# EasyEDA Pro project test_0.eprj (continued)
## Nets (continued)

Not connected (* = marked no-connect by the designer): ADC2 24*; I2S 3*; RGB1 2(DOUT)*; U3 1*; U16 4(SENSOR_VP)* 5(SENSOR_VN)* 17(NC)* 18(NC)* 19(NC)* 20(NC)* 21(NC)* 22(NC)* 32(NC)*; U17 7(NC.)* 8(OUT#)* 9(CTS#)* 10(DSR#)* 11(RI#)* 12(DCD#)* 15(R232)*; USB1 A8(SBU1)* B8(SBU2)*

## Notes on the sheets
sheet 1
- ESP32模组
- 串口与自动下载电路
- RGB彩灯
- LED灯
- 电机控制
- 有源蜂鸣器
- 串口屏
- 超声波
- 音频播放
- 灰度检测
sheet 2
- 充电电路
- 升压电路
- 降压电路
- 充电指示灯
- 电源开关
- 外部电源输入

# Board PCB1
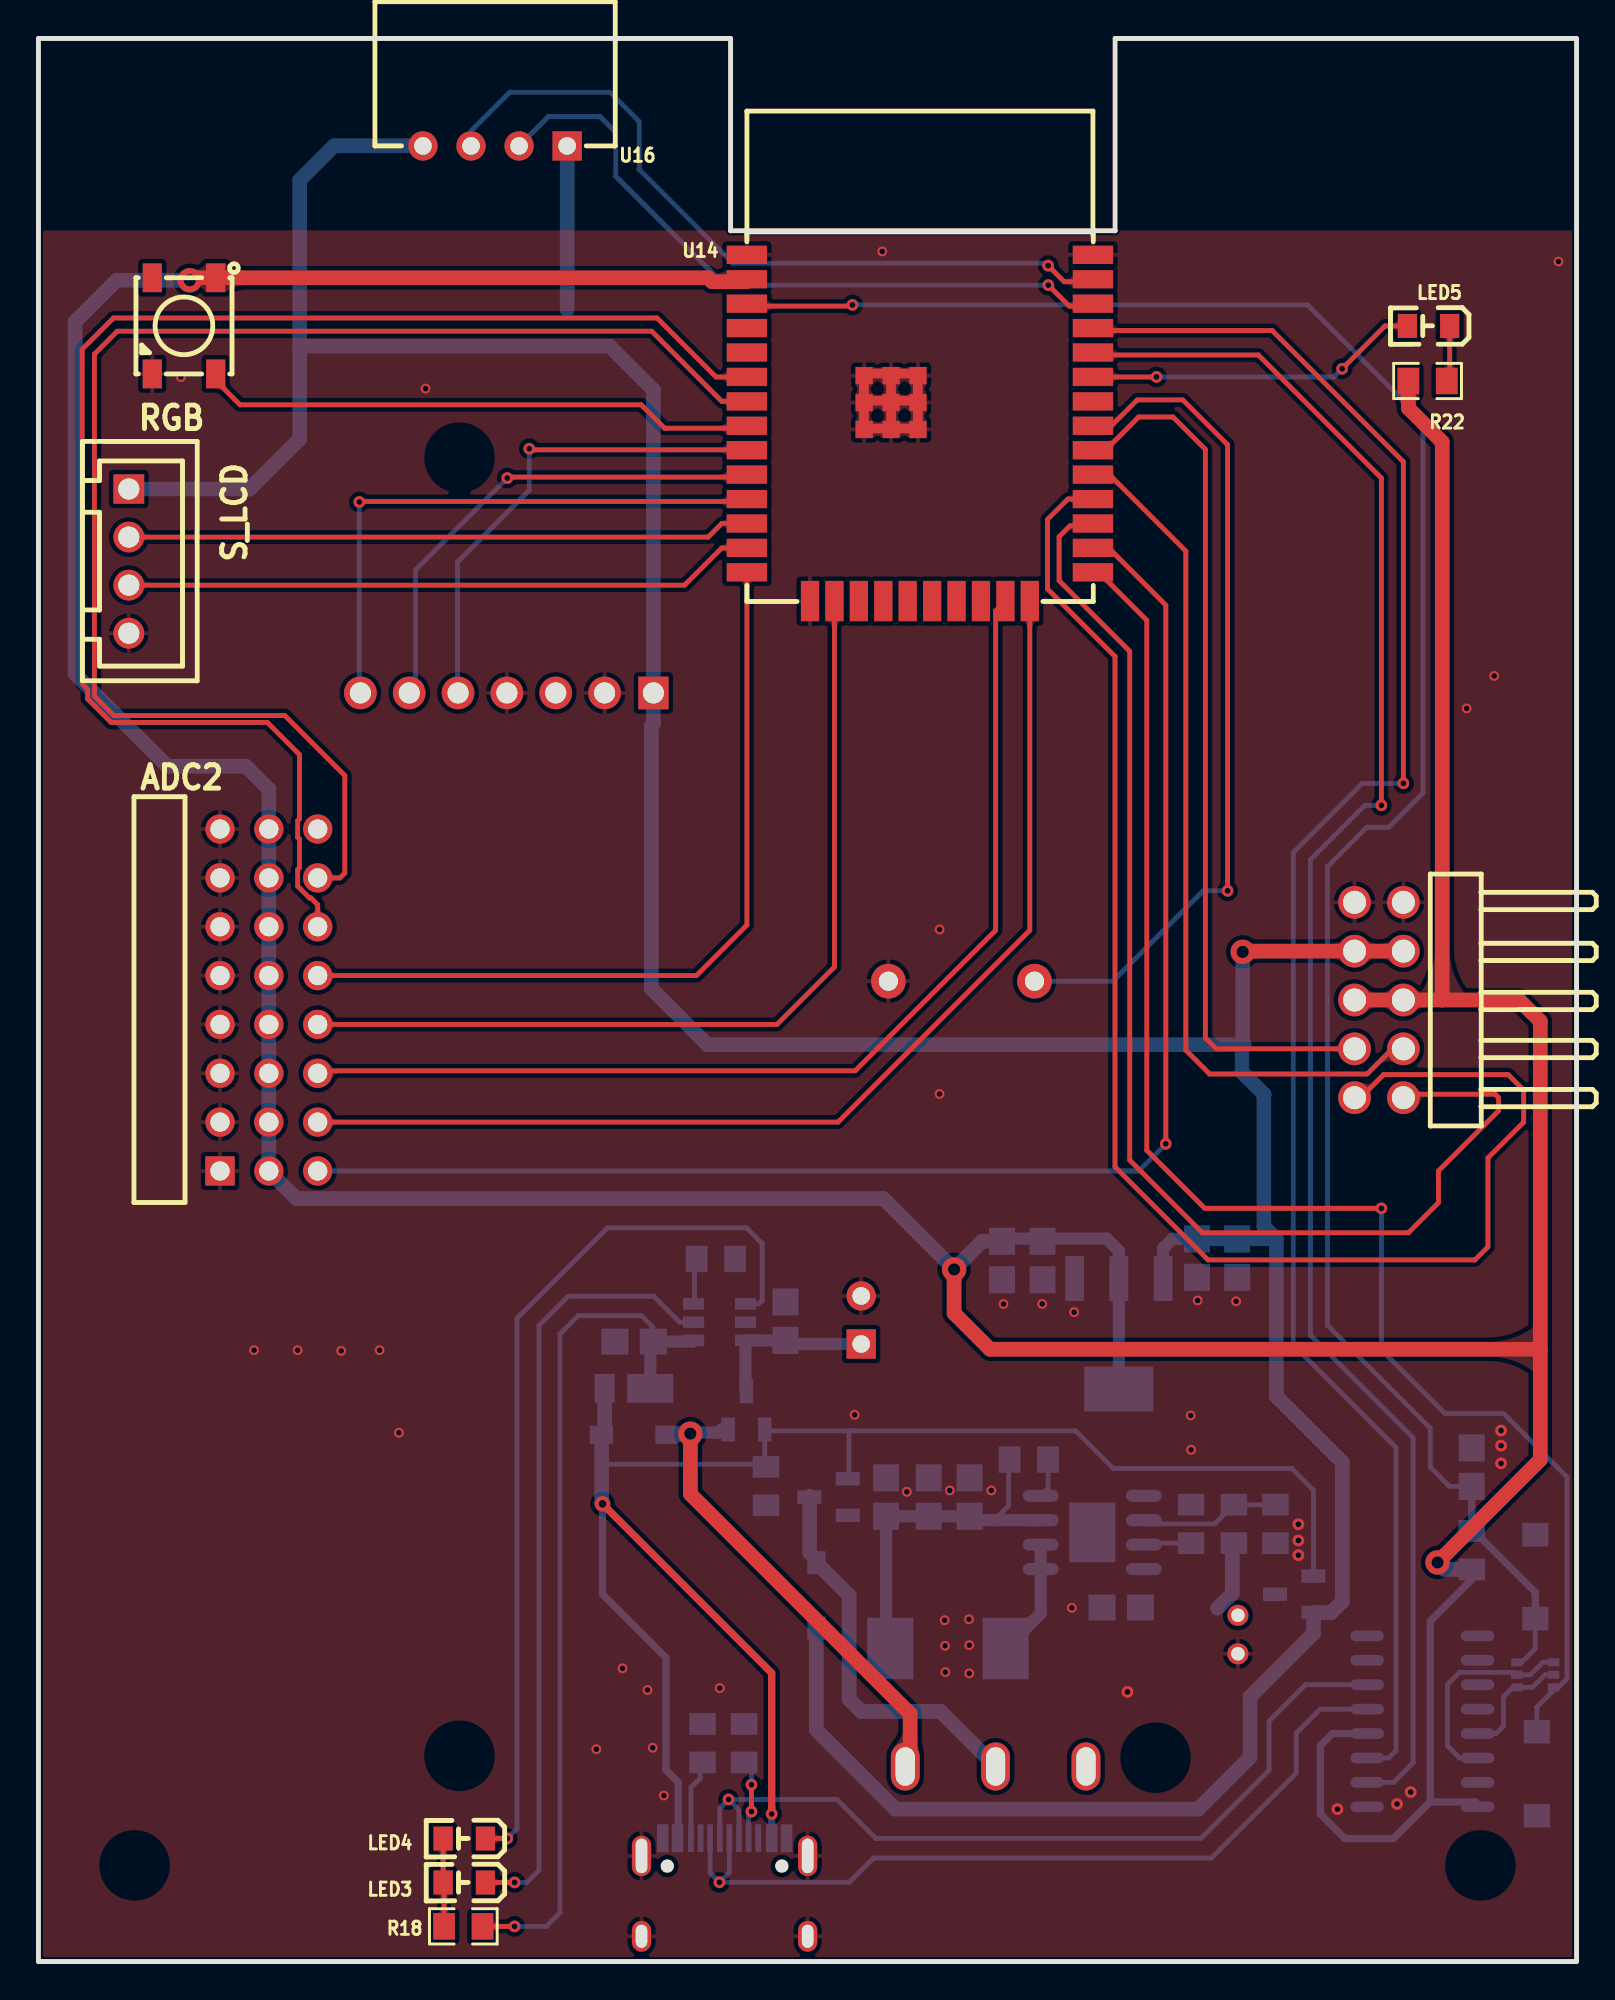
[diagram p3: board, top side]
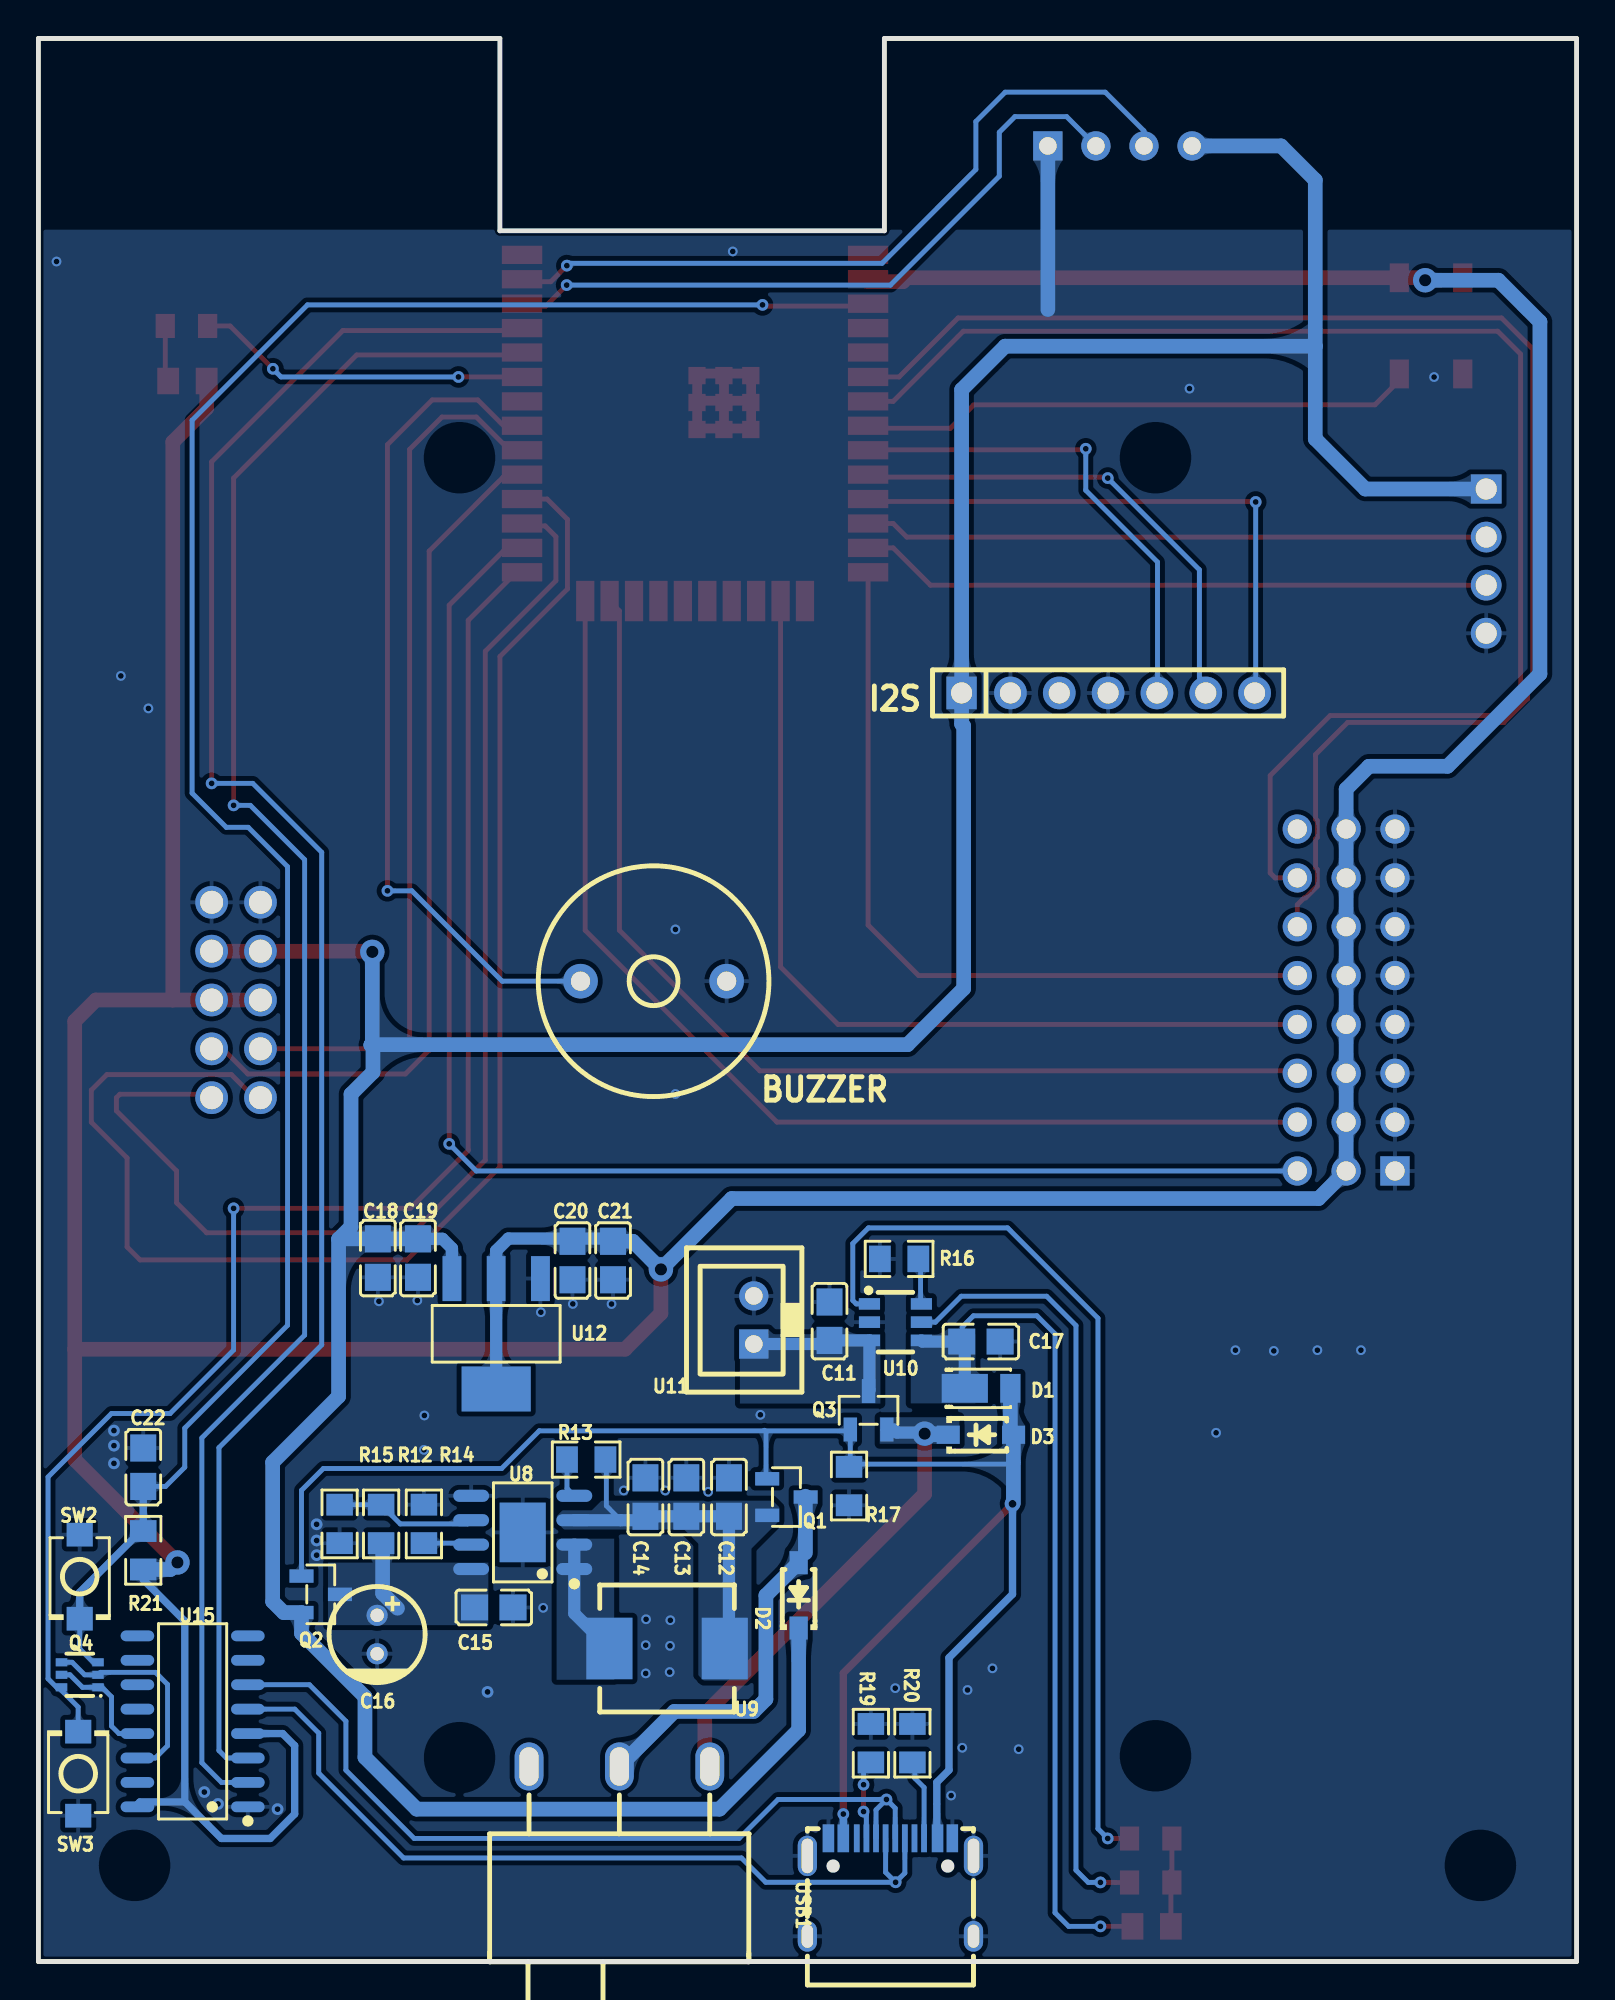
[diagram p4: board, bottom side, seen from below]

Outline 80 x 100 mm; copper layers: Top Layer, Bottom Layer. Coordinates in mm from the lower left corner of the outline.
Outline path: 0,100 36,100 36,90 56,90 56,100 80,100 80,0 0,0 0,100
Stack: Top Layer 0.035mm / Dielectric1 1.51mm FR4 er 4.5 / Bottom Layer 0.035mm

## Design rules (mm)
template: 自定义配置
spacing copperThickness1oz (default): track to track 0.102, other pairs 0.152 to 0.3
spacing copperThickness2oz: track to track 0.203, other pairs 0.152 to 0.3
track width copperThickness1oz (default): min 0.127, default 0.254, max 2.54
track width copperThickness2oz: min 0.203, default 0.254, max 2.54
differential pair differentialPair (default): width min 0.127, default 0.254, max 2.54; gap min 0.152, default 0.152
via viaSize (default): diameter min 0.5, default 0.61, max 10; hole min 0.3, default 0.305, max 6.3
net VCC uses copperRegion1
net BAT uses copperRegion1
net VBUSIN uses copperRegion1
net $2N228 uses copperRegion1
net $2N227 uses copperRegion1
net $2N477 uses copperRegion1

## Placement (name value [footprint] x y rotation side)
ADC2  HX PZ2.54-3x8P ZZ  [HDR-TH_24P-P2.54-V-M-R3-C8-S2.54_1]  11.98 50 90 top
BUZZER  2.4kHz  [BUZ-TH_BD12.0-P7.60-D0.6-FD]  48.01 50.98 180 bottom
C11  10uF  [C0805]  38.86 33.3 270 bottom
C12  22uF  [C0805]  44.09 24.15 270 bottom
C13  22uF  [C0805]  46.3 24.15 270 bottom
C14  100nF  [C0805]  48.43 24.15 270 bottom
C15  22uF  [C0805]  56.32 18.41 0 bottom
C16  100uF  [CAP-TH_BD5.0-P2.00-D0.5-FD]  62.39 17 270 bottom
C17  1uF  [C0805]  30.98 32.24 0 bottom
C18  10uF  [C0805]  62.35 36.58 90 bottom
C19  100nF  [C0805]  60.26 36.58 90 bottom
C20  10uF  [C0805]  52.22 36.45 90 bottom
C21  100nF  [C0805]  50.12 36.45 90 bottom
C22  1uF  [C0805]  74.55 25.71 270 bottom
D1  SBR3U30P1-7  [POWERDI-123_L2.8-W1.8-LS3.7-RD-1]  30.63 29.81 180 bottom
D2  MBR0530T1G  [SOD-123_L2.7-W1.6-LS3.7-RD-1]  40.46 19.04 90 bottom
D3  MBR0530T1G  [SOD-123_L2.7-W1.6-LS3.7-RD-1]  30.98 27.39 180 bottom
H2  HC-PZ254-13.8L-2x5PWA  [HDR-TH_10P-P2.54-H-M-R2-C5-S2.54-W9.7]  69.72 50 90 top
I2S  2541FV-7P-B  [HDR-TH_7P-P2.54-V-F]  24.37 65.97 180 bottom
LED3  -  [LED_0805]  22.1 4.12 180 top
LED4  -  [LED_0805]  22.1 6.4 180 top
LED5  -  [LED_0805]  72.25 85.06 180 top
Q1  -  [SOT-23-3_L2.9-W1.3-P1.90-LS2.4-BR]  41.1 24.15 0 bottom
Q2  -  [SOT-23-3_L2.9-W1.3-P1.90-LS2.4-BR]  65.32 19.09 0 bottom
Q3  -  [SOT-23-3_L2.9-W1.3-P1.90-LS2.4-BR]  36.82 28.66 270 bottom
Q4  UMH3N  [SC-70-6_L2.2-W1.3-P0.65-LS2.1-BR]  77.85 14.91 180 bottom
R12  73K  [R0805]  62.18 22.76 270 bottom
R13  1K  [R0805]  51.51 26.1 0 bottom
R14  30K  [R0805]  59.95 22.76 270 bottom
R15  10K  [R0805]  64.34 22.76 90 bottom
R16  10K  [R0805]  35.24 36.54 180 bottom
R17  100K  [R0805]  37.84 24.73 90 bottom
R18  1K  [R0805]  22.1 1.83 180 top
R19  5.1k  [R0805]  36.7 11.35 90 bottom
R20  5.1k  [R0805]  34.54 11.35 270 bottom
R21  10K  [R0805]  74.55 21.39 270 bottom
R22  10K  [R0805]  72.25 82.19 180 top
RGB  WS2812B-B  [LED-SMD_4P-L5.0-W5.0-BL_TC5050RGB]  7.57 85.06 270 top
S_LCD  ZX-XH2.54-4PZZ  [CONN-TH_4P-P2.50_4PIN]  4.7 72.82 270 top
SW2  TS-1088-AR02016  [SW-SMD_L3.9-W3.0-P4.45]  77.85 20.01 270 bottom
SW3  TS-1088-AR02016  [SW-SMD_L3.9-W3.0-P4.45]  77.93 9.77 90 bottom
U3  KH-SS12D11-G5  [SW-TH_KH-SS12D11-G5]  49.78 5.89 180 bottom
U8  -  [ESOP-8_L4.9-W3.9-P1.27-LS6.0-BL-EP3.1-1]  54.81 22.31 90 bottom
U9  3.3uH  [IND-SMD_L7.0-W6.6]  47.31 16.28 0 bottom
U10  TP4057  [SOT-23-6_L2.9-W1.6-P0.95-LS2.8-BR]  35.43 33.25 0 bottom
U11  BX-XH2.54-2PZZ  [CONN-TH_2P-P2.50_BX-XH2.54-2PZZ]  42.79 33.36 90 bottom
U12  AMS1117-3.3  [SOT-223-3_L6.7-W3.7-P2.30-LS7.0-BR]  56.19 32.64 90 bottom
U14  ESP32-WROOM-32E-H4  [WIFI-SMD_ESP32-WROOM-32E]  45.85 79.75 270 top
U15  CH340C  [SOP-16_L10.0-W3.9-P1.27-LS6.0-BL]  71.98 12.49 90 bottom
U16  ESP32-WROOM-32E-H4  [CONN-TH_4P-P2.50_WAFER-XH254WZ-4A]  23.75 94.41 180 top
USB1  TYPEC-304-BCP16  [USB-C-SMD_TYPEC-304-BCP16]  35.69 3.86 180 bottom

## Footprints (pads in the part's own frame, mm; a bottom-side part is the same pattern mirrored in y, then rotated)
BUZ-TH_BD12.0-P7.60-D0.6-FD
  round 1.8 hole 1: 1(-3.8,0) 2(3.8,0)
C0805
  rect 1.41x1.35 smd: 1(-1,0) 2(1,0)
CAP-TH_BD5.0-P2.00-D0.5-FD
  round 1.1 hole 0.7: 1(-1,0) 2(1,0)
CONN-TH_2P-P2.50_BX-XH2.54-2PZZ
  rect 1.524x1.524 hole 0.914: 1(-1.25,0)
  round 1.524 hole 0.914: 2(1.25,0)
CONN-TH_4P-P2.50_4PIN
  rect 1.524x1.6 hole 1.1: 1(-3.75,0)
  round 1.6 hole 1.1: 2(-1.25,0) 3(1.25,0) 4(3.75,0)
CONN-TH_4P-P2.50_WAFER-XH254WZ-4A
  rect 1.524x1.524 hole 0.914: 1(-3.75,0)
  round 1.524 hole 0.914: 2(-1.25,0) 3(1.25,0) 4(3.75,0)
ESOP-8_L4.9-W3.9-P1.27-LS6.0-BL-EP3.1-1
  oval 0.63x1.865 smd: 1(-1.905,-2.683) 2(-0.635,-2.683) 3(0.635,-2.683) 4(1.905,-2.683) 5(1.905,2.683) 6(0.635,2.683) 7(-0.635,2.683) 8(-1.905,2.683)
  rect 3.1x2.4 smd: 9(0,0)
HDR-TH_7P-P2.54-V-F
  rect 1.575x1.7 hole 1.1: 1(-7.62,0)
  round 1.7 hole 1.1: 2(-5.08,0) 3(-2.54,0) 4(0,0) 5(2.54,0) 6(5.08,0) 7(7.62,0)
HDR-TH_10P-P2.54-H-M-R2-C5-S2.54-W9.7
  round 1.7 hole 1.2: 1(-5.08,1.27) 2(-5.08,-1.27) 3(-2.54,1.27) 4(-2.54,-1.27) 5(0,1.27) 6(0,-1.27) 7(2.54,1.27) 8(2.54,-1.27) 9(5.08,1.27) 10(5.08,-1.27)
HDR-TH_24P-P2.54-V-M-R3-C8-S2.54_1
  rect 1.524x1.524 hole 1: 1(-8.89,2.54)
  round 1.524 hole 1: 2(-6.35,2.54) 3(-3.81,2.54) 4(-1.27,2.54) 5(1.27,2.54) 6(3.81,2.54) 7(6.35,2.54) 8(8.89,2.54) 9(-8.89,0) 10(-6.35,0) 11(-3.81,0) 12(-1.27,0) 13(1.27,0) 14(3.81,0) 15(6.35,0) 16(8.89,0) 17(-8.89,-2.54) 18(-6.35,-2.54) 19(-3.81,-2.54) 20(-1.27,-2.54) 21(1.27,-2.54) 22(3.81,-2.54) 23(6.35,-2.54) 24(8.89,-2.54)
IND-SMD_L7.0-W6.6
  rect 2.4x3.2 smd: 1(-3,0) 2(3,0)
LED-SMD_4P-L5.0-W5.0-BL_TC5050RGB
  rect 1.5x1 smd: 1(-2.5,1.65) 2(-2.5,-1.65) 3(2.5,-1.65) 4(2.5,1.65)
LED_0805
  rect 1x1.25 smd: 1(-1.15,0.005) 2(1.05,0.005)
POWERDI-123_L2.8-W1.8-LS3.7-RD-1
  rect 2.4x1.5 smd: 1(-1.188,0)
  rect 1.05x1.5 smd: 2(1.188,0)
R0805
  rect 1.133x1.377 smd: 1(-1,0) 2(1,0)
SC-70-6_L2.2-W1.3-P0.65-LS2.1-BR
  rect 0.6x0.42 smd: 1(0.95,-0.65) 2(0.95,0) 3(0.95,0.65) 4(-0.95,0.65) 5(-0.95,0) 6(-0.95,-0.65)
SOD-123_L2.7-W1.6-LS3.7-RD-1
  rect 1.2x0.95 smd: 1(-1.7,0) 2(1.7,0)
SOP-16_L10.0-W3.9-P1.27-LS6.0-BL
  oval 0.56x1.745 smd: 1(-4.445,-2.873) 2(-3.175,-2.873) 3(-1.905,-2.873) 4(-0.635,-2.873) 5(0.635,-2.873) 6(1.905,-2.873) 7(3.175,-2.873) 8(4.445,-2.873) 9(4.445,2.873) 10(3.175,2.873) 11(1.905,2.873) 12(0.635,2.873) 13(-0.635,2.873) 14(-1.905,2.873) 15(-3.175,2.873) 16(-4.445,2.873)
SOT-23-3_L2.9-W1.3-P1.90-LS2.4-BR
  rect 1.25x0.7 smd: 1(1,-0.95) 2(1,0.95) 3(-1,0)
SOT-23-6_L2.9-W1.6-P0.95-LS2.8-BR
  rect 1.1x0.6 smd: 1(1.35,-0.95) 2(1.35,0) 3(1.35,0.95) 4(-1.35,0.95) 5(-1.35,0) 6(-1.35,-0.95)
SOT-223-3_L6.7-W3.7-P2.30-LS7.0-BR
  rect 2.34x0.98 smd: 1(2.87,-2.3) 2(2.87,0) 3(2.87,2.3)
  rect 2.34x3.6 smd: 4(-2.87,0)
SW-SMD_L3.9-W3.0-P4.45
  rect 1.23x1.36 smd: 1(-2.185,0) 2(2.185,0)
SW-TH_KH-SS12D11-G5
  oval 1.5x2.5 hole 1x2: 1(-4.7,4.25) 2(0,4.25) 3(4.7,4.25)
USB-C-SMD_TYPEC-304-BCP16
  oval 1x2.1 hole 0.6x1.8: 13(-4.32,1.633) 14(4.32,1.633)
  oval 1x1.6 hole 0.6x1.2: 15(-4.32,-2.547) 16(4.32,-2.547)
  rect 0.6x1.45 smd: A1B12(-3.225,2.547) A4B9(-2.45,2.547) B1A12(3.22,2.547) B4A9(2.45,2.547)
  rect 0.3x1.45 smd: A5(-1.25,2.547) A6(-0.25,2.547) A7(0.25,2.547) A8(1.25,2.547) B5(1.75,2.547) B6(0.75,2.547) B7(-0.75,2.547) B8(-1.75,2.547)
WIFI-SMD_ESP32-WROOM-32E
  rect 0.95x2.1 smd: 1(-9.002,-9) 2(-7.732,-9) 3(-6.463,-9) 4(-5.192,-9) 5(-3.922,-9) 6(-2.652,-9) 7(-1.383,-9) 8(-0.113,-9) 9(1.157,-9) 10(2.428,-9) 11(3.697,-9) 12(4.968,-9) 13(6.237,-9) 14(7.508,-9) 25(7.508,9) 26(6.237,9) 27(4.968,9) 28(3.697,9) 29(2.428,9) 30(1.157,9) 31(-0.113,9) 32(-1.383,9) 33(-2.652,9) 34(-3.922,9) 35(-5.192,9) 36(-6.463,9) 37(-7.732,9) 38(-9.002,9)
  rect 2.1x0.95 smd: 15(9.002,-5.715) 16(9.002,-4.445) 17(9.002,-3.175) 18(9.002,-1.905) 19(9.002,-0.635) 20(9.002,0.635) 21(9.002,1.905) 22(9.002,3.175) 23(9.002,4.445) 24(9.002,5.715)
  rect 0.9x0.9 smd: 39(-2.721,-0.1) 39(-2.721,-1.5) 39(-2.721,-2.9) 39(-1.321,-0.1) 39(-1.321,-1.5) 39(-1.321,-2.9) 39(0.079,-0.1) 39(0.079,-1.5) 39(0.079,-2.9)

## Nets
3V3: ADC2.9 ADC2.10 ADC2.11 ADC2.12 ADC2.13 ADC2.14 ADC2.15 ADC2.16 C20.2 C21.2 H2.5 H2.6 R21.2 R22.2 RGB.1 U12.2 U12.4 U14.2 U15.4 U15.16
5V: C18.2 C19.2 D2.1 H2.7 H2.8 I2S.1 Q2.2 S_LCD.1 U12.3 U16.4
GND: ADC2.1 ADC2.2 ADC2.3 ADC2.4 ADC2.5 ADC2.6 ADC2.7 ADC2.8 BUZZER.2 C11.1 C12.1 C13.1 C14.1 C15.1 C16.2 C17.1 C18.1 C19.1 C20.1 C21.1 C22.1 H2.9 H2.10 I2S.2 I2S.4 R14.1 R15.1 R16.1 R17.1 R19.2 R20.1 RGB.3 S_LCD.4 SW2.1 SW3.1 U8.5 U8.9 U10.2 U11.2 U12.1 U14.1 U14.15 U14.38 U14.39 U15.1 U16.1 USB1.13 USB1.14 USB1.15 USB1.16 USB1.A1B12 USB1.B1A12
VBUS: D1.2 D3.2 Q1.1 Q2.1 Q3.1 R17.2 USB1.A4B9 USB1.B4A9
VBUSIN: D3.1 Q3.2 U3.3
VCC: C17.2 D1.1 R18.1 U10.4
VIN: D2.2 Q1.3 U3.2
340_D+: U15.5 USB1.A6 USB1.B6
340_D-: U15.6 USB1.A7 USB1.B7
ADC1_6: ADC2.22 U14.6
ADC1_7: ADC2.23 U14.7
ADC2_0: ADC2.17 U14.26
ADC2_1: Q4.6 SW3.2 U14.25
ADC2_2: ADC2.18 U14.24
ADC2_3: ADC2.19 U14.23
ADC2_4: ADC2.20 U14.16
ADC2_5: ADC2.21 U14.14
BAT: C11.2 Q3.3 U10.3 U11.1
BEEP: BUZZER.1 U14.31
CHIP_PU: C22.2 Q4.3 R21.1 SW2.2 U14.3
CHRG: LED4.1 U10.1
DIRE1: H2.3 U14.30
DIRE2: H2.4 U14.29
DTR: Q4.1 Q4.5 U15.13
ECHO: U14.36 U16.2
I2S_1: I2S.5 U14.9
I2S_2: I2S.6 U14.10
I2S_3: I2S.7 U14.11
LED: LED5.2 U14.33
PWM1: H2.1 U14.28
PWM2: H2.2 U14.27
RGB: RGB.4 U14.8
RTS: Q4.2 Q4.4 U15.14
RX: S_LCD.2 U14.12
RXD0: U14.34 U15.2
STDBY: LED3.1 U10.5
TRIG: U14.37 U16.3
TX: S_LCD.3 U14.13
TXD0: U14.35 U15.3
$2N227: U8.1 U8.2 U9.2
$2N228: C12.2 C13.2 C14.2 Q1.2 R13.1 U8.3 U9.1
$2N230: R13.2 U8.4
$2N472: R14.2 U8.7
$2N473: R12.1 R15.2 U8.6
$2N477: C15.2 C16.1 Q2.3 R12.2 U8.8
$2N943: R19.1 USB1.A5
$2N948: R20.2 USB1.B5
$2N1528: R16.2 U10.6
$2N1721: LED3.2 LED4.2 R18.2
$3N5638: LED5.1 R22.1

Pads without a net: ADC2 24; I2S 3; RGB 2; U3 1; U14 4 5 17 18 19 20 21 22 32; U15 7 8 9 10 11 12 15; USB1 A8 B8

## Via types
v1: diameter 0.508, hole 0.3, Top Layer to Bottom Layer, 37 vias
v2: diameter 0.61, hole 0.305, Top Layer to Bottom Layer, 31 vias
v3: diameter 0.813, hole 0.406, Top Layer to Bottom Layer, 1 via
v4: diameter 1.27, hole 0.635, Top Layer to Bottom Layer, 5 vias

## Routing (per net, layer and track width the routed paths; a pad name or vN(x,y) marks a point on that pad's centre or on a via; arc(x,y) is an arc through that point)
3V3: length 278.1
  Top Layer w0.762: v4(72.77,20.75) 78.11,26.09 78.11,31.84 ; 78.11,31.84 78.11,48.9 77.01,50 73.01,50 ; 78.11,31.84 49.49,31.84 47.62,33.71 v4(47.62,35.99) ; R22.2 71.25,80.78 73.01,79.01 73.01,50 ; H2.5 73.01,50 ; 36.85,87.35 35.03,87.35 34.83,87.56 RGB.1 8,87.56 v4(7.87,87.43)
  Bottom Layer w0.381: U15.4 67.3,11.85 66.68,11.23 66.68,7.67 67.94,6.4 70.49,6.4 72.39,8.31 ; R21.2 74.55,19.86 72.39,17.7 72.39,8.31 ; 72.39,8.31 72.39,8.3 74.73,8.3 74.85,8.17 U15.16
  Bottom Layer w0.635: U12.4 U12.2 56.19,36.96 55.56,37.6 50.26,37.6
  Bottom Layer w0.762: R21.2 73.14,20.39 v4(72.77,20.75) ; 11.98,44.26 ADC2.11 ADC2.12 ADC2.13 ADC2.14 ADC2.15 ADC2.16 11.98,60.97 10.8,62.15 6.71,62.15 1.91,66.96 1.91,85.27 4.06,87.43 v4(7.87,87.43) ; C21.2 49.09,37.45 v4(47.62,35.99) 43.94,39.67 13.42,39.67 ADC2.9 ADC2.10
5V: length 206.5
  Top Layer w0.762: v4(62.64,52.5) 62.67,52.54 H2.7 70.99,52.54
  Bottom Layer w0.635: U12.3 58.49,37.09 58.98,37.58 C19.2
  Bottom Layer w0.762: 62.69,47.68 62.71,47.66 62.6,47.55 62.6,46.25 63.74,45.1 63.74,38.21 64.37,37.58 ; 62.69,47.68 62.64,47.73 v4(62.64,52.5) ; 62.69,47.68 34.8,47.68 31.88,50.6 31.88,64.25 31.99,64.36 I2S.1 31.99,81.73 29.72,84 13.59,84 ; 13.59,84 13.59,79.18 10.98,76.57 S_LCD.1 ; 13.59,84 13.59,92.63 15.37,94.41 U16.4 ; C19.2 C18.2 64.37,37.58 ; 64.37,37.58 64.39,37.56 64.39,29.39 67.82,25.96 67.82,18.72 67.24,18.14 Q2.2 66.32,17.07 63.02,13.77 63.02,10.62 60.32,7.93 44.58,7.93 40.46,12.04 D2.1
GND: length 25.9
  Top Layer w0.508: 44.34,81.16 45.74,81.16 ; 44.34,81.16 44.34,79.72 ; 44.34,81.16 44.34,82.57 ; 44.34,81.16 42.93,81.16 ; 45.74,81.16 45.77,81.16 45.79,81.18 ; 45.74,81.16 45.74,82.55 ; 45.74,81.16 45.74,79.8 ; 44.35,79.72 45.66,79.72 45.74,79.8 ; 44.34,82.59 44.34,82.57 ; 44.34,82.57 45.74,82.57 ; 44.34,82.57 42.93,82.57 ; 42.93,79.72 42.93,81.16 ; 42.93,79.72 42.85,79.72 ; 42.93,79.72 42.93,79.7 42.86,79.63 ; 42.93,79.72 44.34,79.72 ; 42.93,81.16 42.9,81.16 ; 42.93,81.16 42.93,82.57 ; 44.34,79.72 44.34,79.68 44.32,79.66 ; 42.93,82.57 42.91,82.59 ; 45.74,79.8 45.77,79.83
  Bottom Layer w0.762: U16.1 27.5,85.9
  vias: v1(7.41,82.39) v1(11.21,31.79) v1(13.48,31.79) v1(15.75,31.75) v1(17.74,31.79) v1(18.75,27.5) v1(20.13,81.79) v1(29.02,11.04) v1(30.38,15.25) v1(31.68,14.12) v1(31.95,11.12) v1(32.53,8.63) v1(35.44,14.22) v1(42.45,28.43) v1(43.89,88.92) v1(45.17,24.43) v1(46.87,53.67) v1(46.87,45.11) v1(47.13,17.75) v1(47.15,16.42) v1(47.17,15.05) v1(47.4,24.5) v1(48.4,17.8) v1(48.41,16.45) v1(48.41,14.98) v1(49.56,24.5) v1(50.19,34.19) v1(52.21,34.2) v1(53.75,18.39) v1(53.87,33.76) v1(59.93,28.39) v1(59.95,26.61) v1(60.29,34.38) v1(62.29,34.33) v1(74.28,65.16) v1(75.72,66.85) v1(79.06,88.4) v2(56.64,14.02) v2(65.53,22.74) v2(65.53,21.9) v2(65.53,21.13) v2(67.56,7.93) v2(70.66,8.19) v2(71.37,8.81) v2(76.07,27.61) v2(76.07,26.83) v2(76.07,25.91)
VBUS: length 93
  Top Layer w0.381: v2(38.14,7.67) 38.14,15 v3(29.34,23.8)
  Bottom Layer w0.254: 37.89,27.64 37.93,27.59 42.21,27.59 ; 37.77,25.79 Q3.1 ; Q2.1 66.32,24.5 65.18,25.64 55.91,25.64 53.95,27.6 42.22,27.6 ; 37.72,25.86 29.37,25.86 29.29,25.94 ; 42.16,27.54 42.16,25.22 ; 42.24,27.62 42.22,27.6 ; 42.22,27.6 42.21,27.59
  Bottom Layer w0.381: 29.29,23.85 v3(29.34,23.8) 29.34,19.1 32.64,15.8 32.64,9.96 33.27,9.32 33.27,8.22 ; 33.27,8.15 33.27,6.45 33.24,6.41 ; USB1.A4B9 v2(38.14,7.67)
  Bottom Layer w0.762: D1.2 29.45,27.56 D3.2 29.29,27.38 29.29,23.86
VBUSIN: length 26.7
  Top Layer w0.762: U3.3 45.34,10.4 45.34,12.88 33.91,24.31 33.91,27.48
  Bottom Layer w0.635: D3.1 32.79,27.51 35.35,27.51 35.51,27.66 Q3.2
  Bottom Layer w0.762: D3.1 33.85,27.39 v4(33.91,27.45)
VCC: length 45
  Top Layer w0.254: v2(24.76,1.83) R18.1
  Bottom Layer w0.254: 31.95,32.24 31.95,33 31.37,33.58 28.07,33.58 27.13,32.64 27.13,2.54 26.42,1.83 v2(24.76,1.83)
  Bottom Layer w0.635: U10.4 34.02,32.24 C17.2 ; 31.82,29.81 31.82,32.08
VIN: length 19.8
  Bottom Layer w0.762: D2.2 42.16,19.04 42.16,13.64 42.8,13 46.92,13 U3.2 ; 40.11,24.2 40.11,21.25
340_D+: length 43.6
  Bottom Layer w0.254: USB1.A6 35.94,4.64 v2(35.42,4.12) ; U15.5 66.67,13.12 65.42,11.88 65.42,9.8 61.01,5.38 43.43,5.38 42.17,4.12 v2(35.42,4.12) ; USB1.B6 34.94,4.6 v2(35.42,4.12)
340_D-: length 43.3
  Bottom Layer w0.254: v2(35.89,8.43) 41.53,8.43 43.56,6.4 60.46,6.4 64.01,9.95 64.01,12.5 65.91,14.39 U15.6 ; v2(35.89,8.43) 35.44,7.97 USB1.A7 ; v2(35.89,8.43) 36.44,7.88 USB1.B7
ADC1_6: length 76.6
  Top Layer w0.254: U14.6 35.24,82.4 32.17,85.47 3.9,85.47 2.27,83.84 2.27,66.44 2.55,66.16 2.55,65.66 3.78,64.43 11.91,64.43 13.58,62.76 13.58,59.42 13.48,59.32 13.48,58.46 13.58,58.36 13.58,56.88 13.48,56.78 13.48,55.92 14.09,55.31 14.17,55.31 14.52,54.95 ADC2.22
ADC1_7: length 75
  Top Layer w0.254: U14.7 35.54,81.13 31.9,84.78 4.1,84.78 2.91,83.59 2.91,65.81 3.93,64.79 12.82,64.79 15.93,61.67 15.93,56.6 15.68,56.35 ADC2.23
ADC2_0: length 77.8
  Top Layer w0.254: v2(58.64,42.52) 58.64,70.53 55.78,73.38 54.85,73.38
  Bottom Layer w0.254: v2(58.64,42.52) 57.23,41.11 14.4,41.11
ADC2_1: length 78.6
  Top Layer w0.254: v2(69.85,39.17) 60.66,39.17 57.65,42.18 57.65,69.74 55.28,72.11 54.85,72.11
  Bottom Layer w0.254: 78.91,14.21 77.93,13.23 SW3.2 ; v2(69.85,39.17) 69.85,31.8 73.15,28.5 76.2,28.5 79.5,25.2 79.5,14.71 79.05,14.25 78.79,14.25
ADC2_2: length 58.3
  Top Layer w0.254: ADC2.18 41.59,43.65 51.56,53.62 U14.24
ADC2_3: length 55.7
  Top Layer w0.254: ADC2.19 14.65,46.32 42.48,46.32 49.78,53.62 49.78,70.24 U14.23
ADC2_4: length 47.1
  Top Layer w0.254: U14.16 41.4,51.72 38.41,48.73 ADC2.20
ADC2_5: length 41.8
  Top Layer w0.254: U14.14 36.85,53.9 34.22,51.27 ADC2.21
BAT: length 8.7
  Bottom Layer w0.635: Q3.3 36.78,29.71 U10.3 C11.2 39.04,32.11 U11.1
BEEP: length 43.5
  Top Layer w0.254: 54.97,79.73 55.68,79.73 57.15,81.2 59.52,81.2 61.85,78.87 v2(61.85,55.68)
  Bottom Layer w0.254: v2(61.85,55.68) 60.58,55.68 55.88,50.98 51.93,50.98
CHIP_PU: length 110.6
  Top Layer w0.254: v2(42.34,86.15) 42.28,86.08 36.85,86.08
  Bottom Layer w0.254: SW2.2 77.85,16.26 77.1,15.51 ; v2(42.34,86.15) 66.01,86.15 72.01,80.14 72.01,60.76 70.23,58.98 69.09,58.98 67.04,56.94 67.04,33.08 72.39,27.74 72.39,25.71 73.39,24.71 C22.2
  Bottom Layer w0.381: C22.2 R21.1 74.67,22.39 77.85,19.2 SW2.2
CHRG: length 47.3
  Top Layer w0.254: v2(24.38,6.4) 23.25,6.4 LED4.1
  Bottom Layer w0.254: v2(24.38,6.4) 24.89,6.91 24.89,33.45 29.59,38.15 36.83,38.15 37.64,37.34 37.64,34.38 37.47,34.2 U10.1
DIRE1: length 45.9
  Top Layer w0.254: H2.3 61.26,47.46 60.69,48.03 60.69,78.63 59.01,80.31 57.22,80.31 55.37,78.46 54.85,78.46
DIRE2: length 44.7
  Top Layer w0.254: 70.99,47.46 70.42,47.46 69.11,46.15 60.92,46.15 59.68,47.39 59.68,73.34 55.83,77.19 54.85,77.19
DTR: length 6.1
  Bottom Layer w0.254: Q4.5 78.36,14.91 77.71,14.26 Q4.1 76.69,14.26 76.2,13.77 76.2,12.24 75.81,11.85 U15.13
ECHO: length 36
  Top Layer w0.254: 54.97,86.08 53.62,86.08 v2(52.53,87.17)
  Bottom Layer w0.254: U16.2 26.52,95.94 29.21,95.94 30.02,95.12 30.02,92.84 35.69,87.17 v2(52.53,87.17)
I2S_1: length 25.6
  Top Layer w0.152: 25.75,78.61 25.58,78.61 v2(25.53,78.66)
  Top Layer w0.254: 25.75,78.61 36.7,78.61 36.85,78.46
  Bottom Layer w0.254: v2(25.53,78.66) 25.53,76.5 21.8,72.77 21.8,66.16 21.68,66.04
I2S_2: length 25.4
  Top Layer w0.254: v2(24.38,77.14) 24.44,77.19 36.85,77.19
  Bottom Layer w0.254: v2(24.38,77.14) 19.62,72.37 19.62,66.78 19.2,66.37
I2S_3: length 30.2
  Top Layer w0.254: 36.85,75.92 16.71,75.92 v2(16.69,75.9)
  Bottom Layer w0.254: 16.72,65.88 16.69,65.91 v2(16.69,75.9)
LED: length 17.5
  Top Layer w0.254: v2(67.81,82.82) 70.03,85.05 LED5.2 ; U14.33 v2(58.15,82.4)
  Bottom Layer w0.254: v2(67.81,82.82) 67.38,82.4 v2(58.15,82.4)
PWM1: length 78.2
  Top Layer w0.254: 54.85,75.92 54.72,76.05 53.54,76.05 52.48,74.99 52.48,71.37 56,67.86 56,41.32 60.84,36.48 74.72,36.48 75.39,37.16 75.39,41.79 77.25,43.65 77.25,45.31 76.44,46.12 69.97,46.12 68.76,44.92 H2.1
PWM2: length 66.1
  Top Layer w0.254: 54.85,74.65 53.65,74.65 53.09,74.09 53.09,71.81 56.76,68.13 56.76,41.68 60.54,37.9 71.25,37.9 72.82,39.46 72.82,41.11 75.95,44.24 75.95,44.92 75.77,45.1 71.17,45.1 70.99,44.92
RGB: length 28.3
  Top Layer w0.254: 9.45,81.98 10.48,80.95 31.35,80.95 32.57,79.73 36.85,79.73
RTS: length 11.1
  Bottom Layer w0.254: Q4.4 78.25,15.56 77.6,14.91 Q4.2 76.77,15.04 73.91,15.04 73.29,14.41 73.29,11.22 73.92,10.58 U15.14
RX: length 32.4
  Top Layer w0.254: S_LCD.2 34.84,74.07 35.54,74.78 U14.12
RXD0: length 91.4
  Top Layer w0.254: v2(69.85,60.12) 69.85,77.14 63.45,83.54 54.97,83.54
  Bottom Layer w0.254: v2(69.85,60.12) 68.98,60.12 66.16,57.3 66.16,32.57 71.5,27.23 71.5,10.34 70.48,9.31 U15.2
STDBY: length 40.6
  Top Layer w0.254: LED3.1 24,4.11 24.01,4.12 v2(24.76,4.12)
  Bottom Layer w0.254: U10.5 33.35,33.25 32,34.59 27.56,34.59 26.03,33.07 26.03,4.75 25.4,4.12 v2(24.76,4.12)
TRIG: length 39.6
  Top Layer w0.254: 54.97,87.35 53.35,87.35 v2(52.52,88.19)
  Bottom Layer w0.254: U16.3 22.5,95.19 24.51,97.21 29.72,97.21 31.24,95.68 31.24,93.19 36.12,88.31 52.4,88.31 v2(52.52,88.19)
TX: length 33
  Top Layer w0.254: S_LCD.3 33.61,71.57 35.54,73.51 U14.13
TXD0: length 93.4
  Top Layer w0.254: v2(70.99,61.27) 70.99,77.99 64.17,84.81 54.97,84.81
  Bottom Layer w0.254: U15.3 70.22,10.58 70.61,10.97 70.61,26.72 65.27,32.07 65.27,57.68 68.85,61.27 v2(70.99,61.27)
$2N227: length 6.2
  Bottom Layer w0.635: U8.2 U8.1 52.13,18.1 U9.2
$2N228: length 18.6
  Bottom Layer w0.254: R13.1 50.46,26.05 50.46,23.7 49.71,22.95
  Bottom Layer w0.635: U8.3 48.63,22.95 C14.2 C13.2 C12.2 44.09,16.5 U9.1
$2N230: length 2
  Bottom Layer w0.254: R13.2 52.51,24.6 U8.4
$2N472: length 2.5
  Bottom Layer w0.254: R14.2 57.57,21.76 U8.7
$2N473: length 7.3
  Bottom Layer w0.254: R15.2 R12.1 61.18,22.76 57.69,22.76 U8.6
$2N477: length 3.5
  Bottom Layer w0.762: 62.1,21.59 62.1,19.14 61.32,18.37
$2N943: length 4.3
  Top Layer w0.254: v2(37.08,9.19) v2(37.08,7.8)
  Bottom Layer w0.254: USB1.A5 36.94,7.65 v2(37.08,7.8) ; v2(37.08,9.19) 37.08,10 36.66,10.43
$2N948: length 4.1
  Bottom Layer w0.254: 34.42,10.35 34.42,9.53 33.94,9.05 USB1.B5
$2N1528: length 2.1
  Bottom Layer w0.254: 34.12,34.25 34.12,36.11 34.21,36.19 ; U10.6 34.02,34.25
$2N1721: length 4.2
  Top Layer w0.254: LED4.2 21.05,4.75 21.1,4.69 21.1,2.21
$3N5638: length 2.9
  Top Layer w0.254: R22.1 73.4,82.34 LED5.1

## Copper pours and planes (outline as drawn; the poured copper is in the pictures)
GND on Top Layer: 0.01,90 79.98,90 79.98,0.23 0.01,0.23
GND on Bottom Layer: 0.08,90.06 79.96,90.06 79.96,0.25 0.08,0.25
VBUSIN on Bottom Layer: 32.1,28.31 36.25,28.31 36.25,26.92 32.1,26.92
VCC on Bottom Layer: 31.26,32.6 34.63,32.6 34.63,29.02 31.26,29.02
BAT on Bottom Layer: 36.21,32.62 43.52,32.62 43.52,29.01 36.21,29.01
$2N227 on Bottom Layer: 50.06,21.99 53.05,21.99 53.05,14.65 50.06,14.65
$2N228 on Bottom Layer: 43.19,14.61 42.91,14.88 42.91,21.47 41.46,22.93 41.46,23.61 41.81,23.97 50.72,23.97 51.22,23.47 52.74,23.47 53.04,23.17 53.04,22.84 52.67,22.47 46.42,22.47 45.68,21.73 45.68,14.89 45.4,14.61
$2N477 on Bottom Layer: 56.6,20.75 64.94,20.75 64.94,17.49 56.6,17.49

Small or netless copper shapes (teardrops, artwork), in the pictures only: 108 on Top Layer, 168 on Bottom Layer
